# EAGLE schematic MSP-EXP430FR4133_EagleCAD (EAGLE 7.6.0)
REV: 1.1

## Sheet 1 of 6
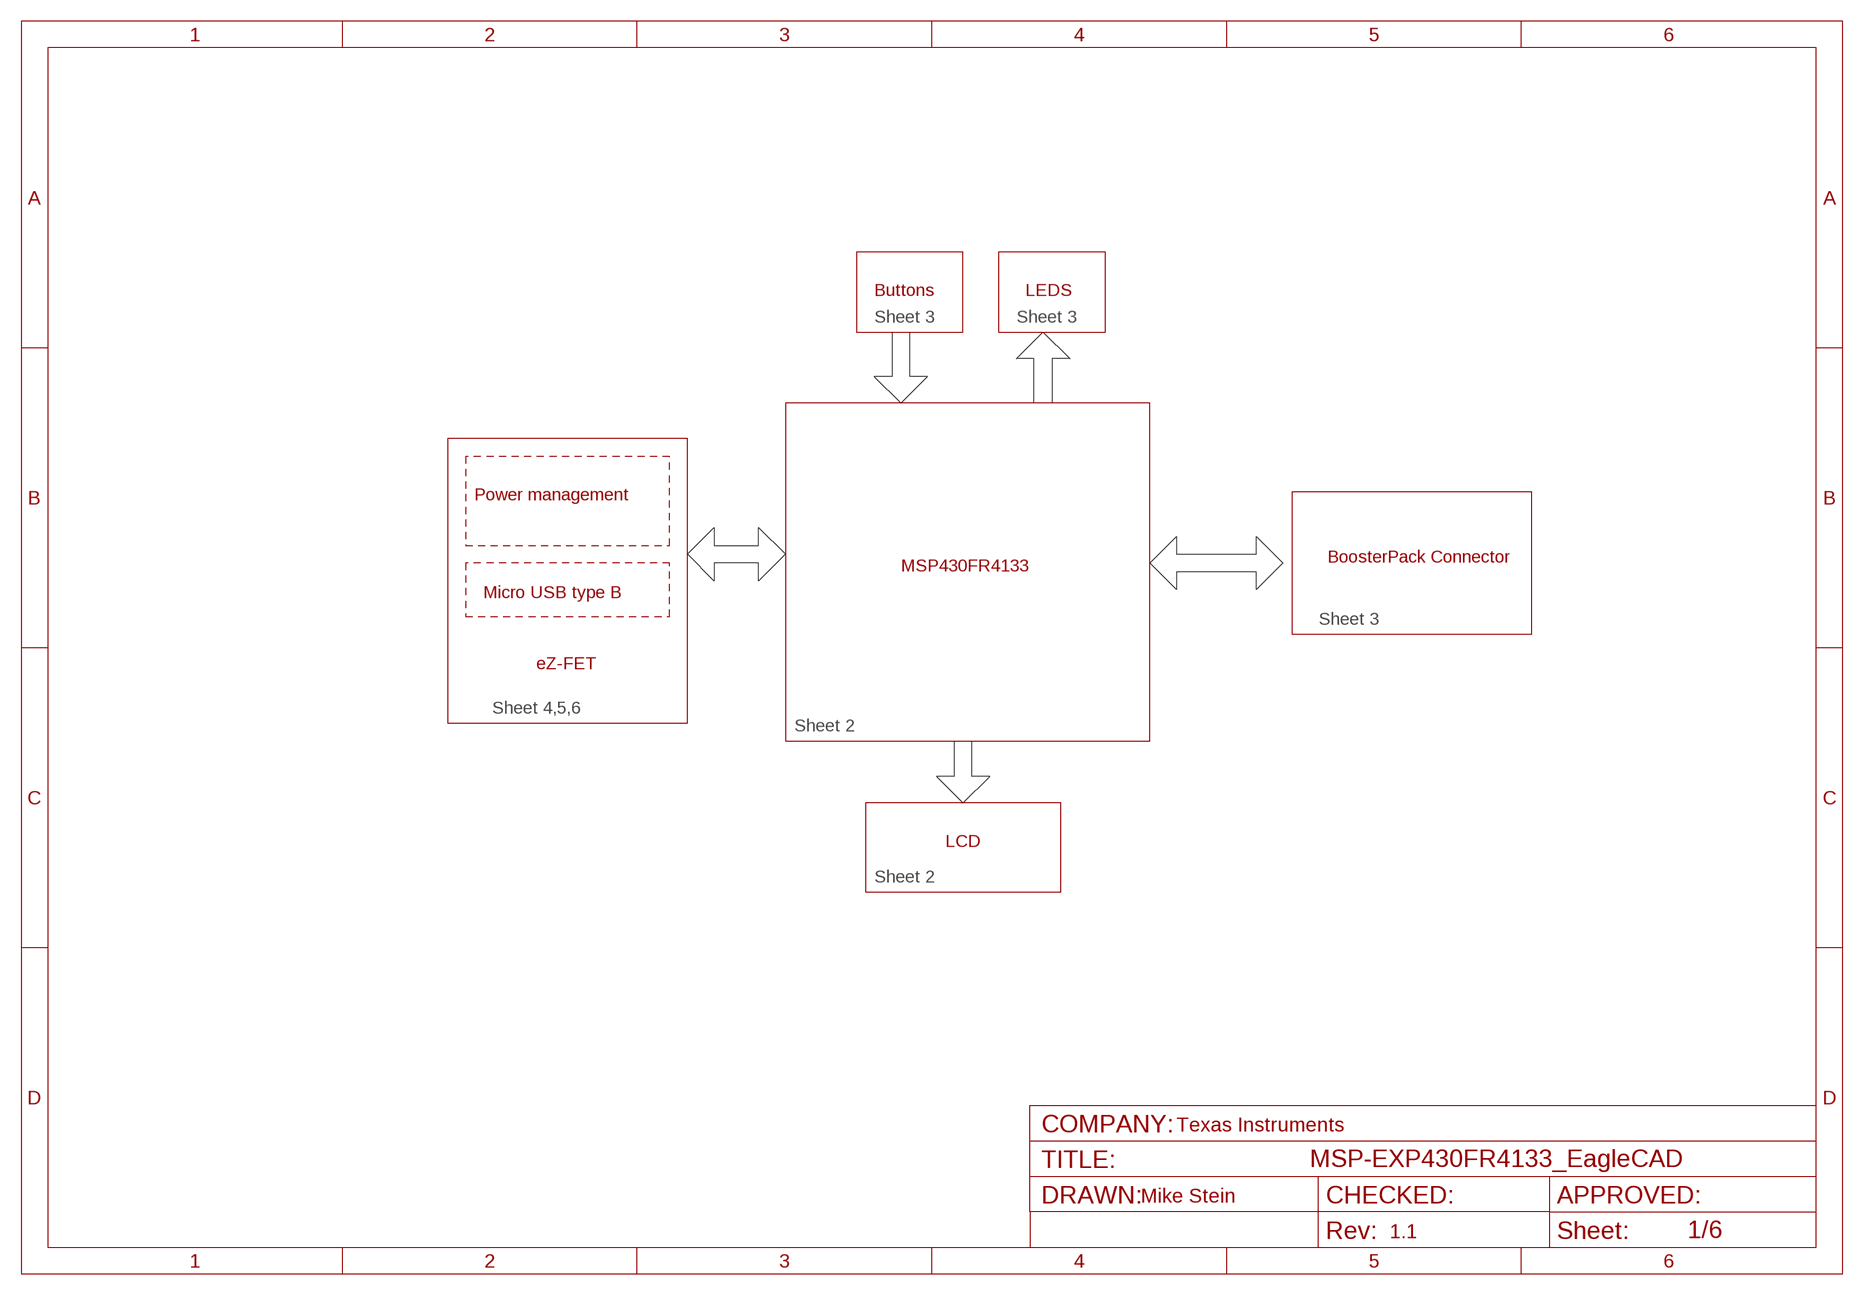
[diagram p0: schematic, sheet 1]

### Notes on the sheet
- Buttons | LEDS
- Sheet 3 | Sheet 3
- Power management
- BoosterPack Connector
- MSP430FR4133
- Micro USB type B
- Sheet 3
- eZ-FET
- Sheet 4,5,6
- Sheet 2
- LCD
- Sheet 2
- Texas Instruments
- Mike Stein

## Sheet 2 of 6
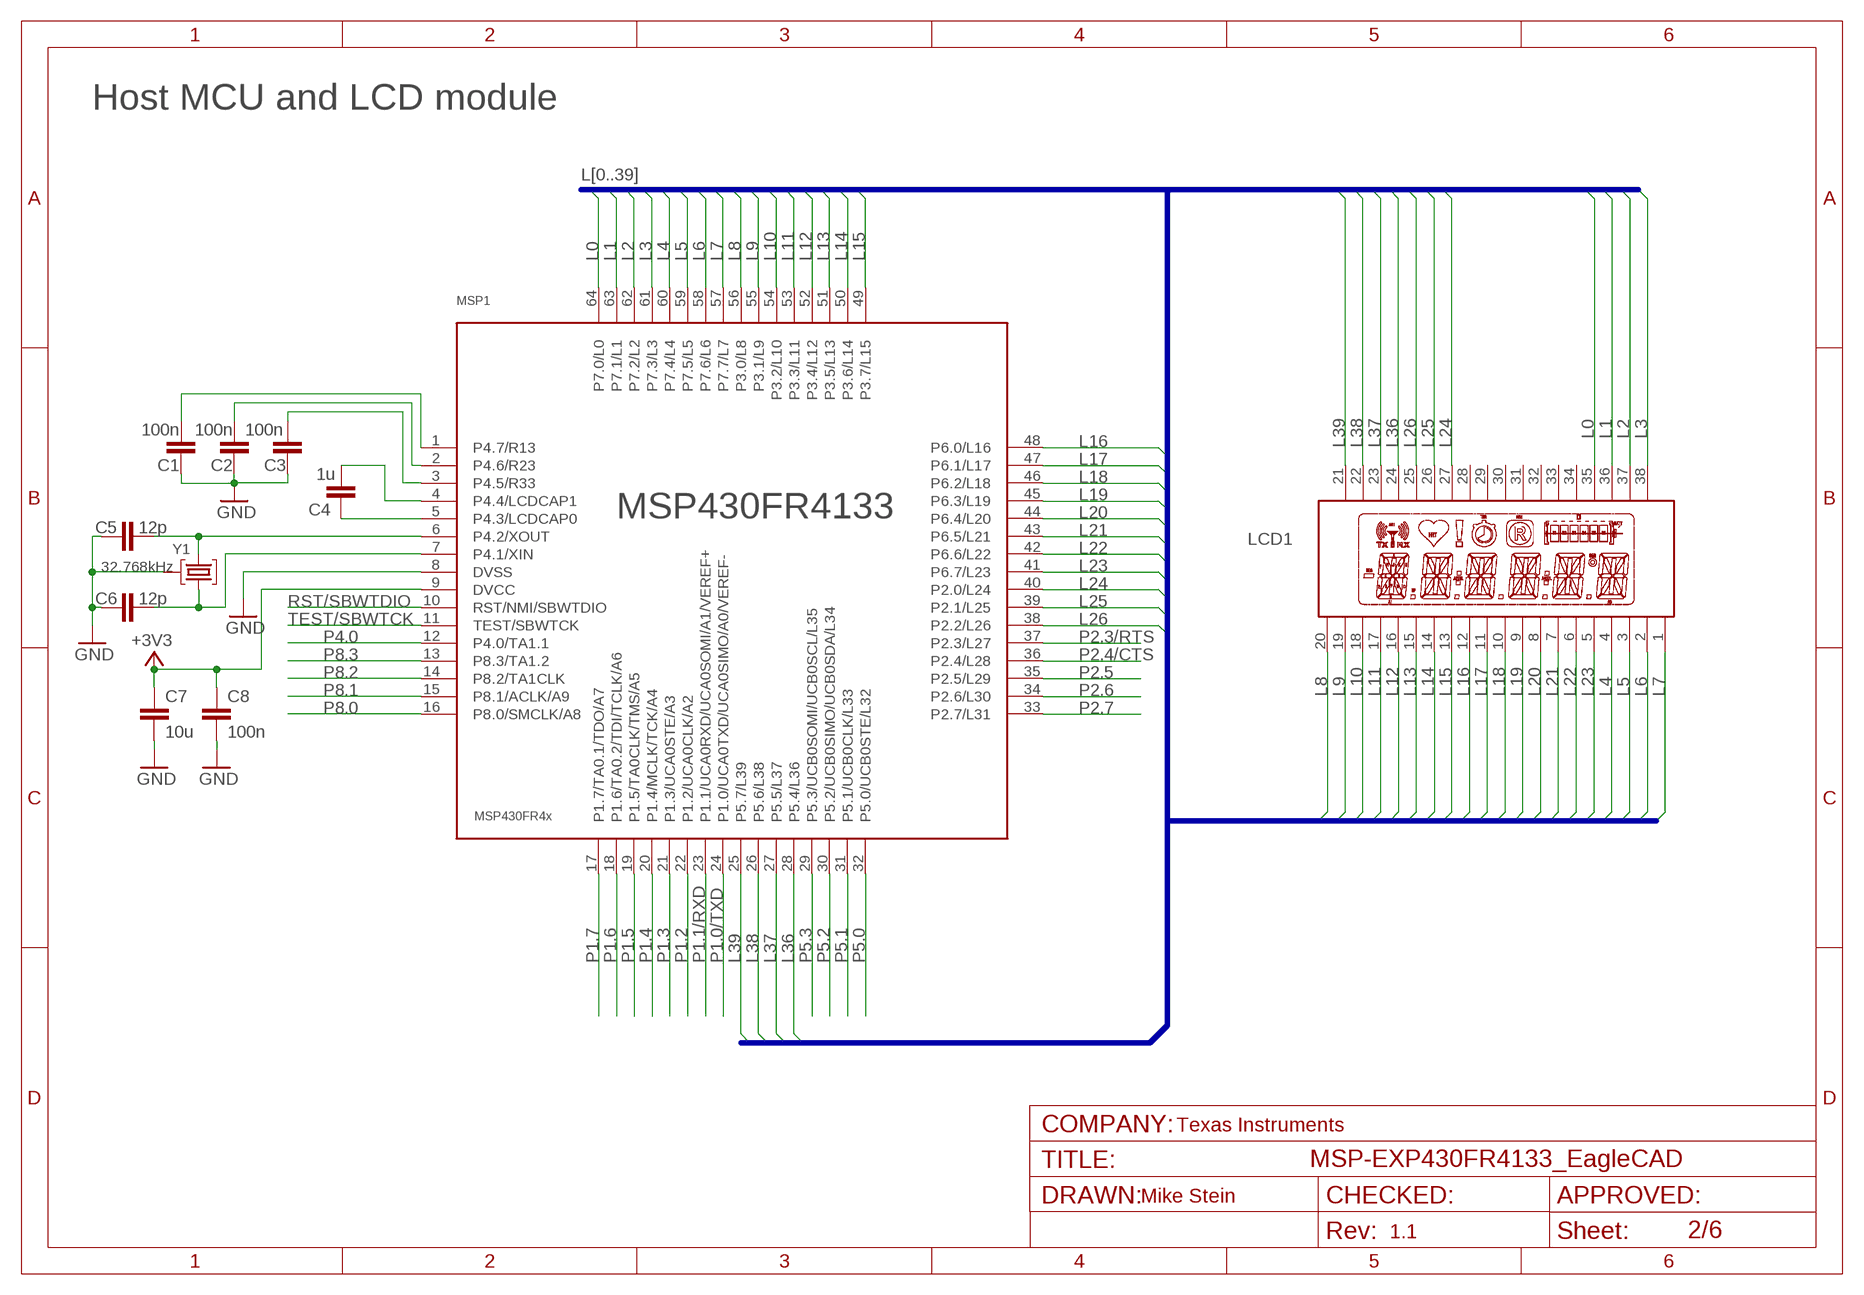
[diagram p1: schematic, sheet 2]

### Parts
C1  100n  C-EUC0402  [C0402]
C2  100n  C-EUC0402  [C0402]
C3  100n  C-EUC0402  [C0402]
C4  1u  C-EUC0402  [C0402]
C5  12p  C-EUC0402  [C0402]
C6  12p  C-EUC0402  [C0402]
C7  10u  C-EUC0603  [C0603]
C8  100n  C-EUC0402  [C0402]
LCD1  FH1138P  [FH1138P]
MSP1  MSP430FR4x  MSP430G621IPM  [LQFP64]
Y1  32.768kHz  MS3V-T1R  [MS3V-T1R]

### Nets
+3V3: C7.1 C8.1 MSP1.9(DVCC) ; also sheet 3,5
GND: C1.2 C2.2 C3.2 C5.2 C6.2 C7.2 C8.2 MSP1.8(DVSS) Y1.P3(GND) ; also sheet 3,4,5,6
L0: LCD1.35 MSP1.64(P7.0/L0)
L1: LCD1.36 MSP1.63(P7.1/L1)
L2: LCD1.37 MSP1.62(P7.2/L2)
L3: LCD1.38 MSP1.61(P7.3/L3)
L4: LCD1.4 MSP1.60(P7.4/L4)
L5: LCD1.3 MSP1.59(P7.5/L5)
L6: LCD1.2 MSP1.58(P7.6/L6)
L7: LCD1.1 MSP1.57(P7.7/L7)
L8: LCD1.20 MSP1.56(P3.0/L8)
L9: LCD1.19 MSP1.55(P3.1/L9)
L10: LCD1.18 MSP1.54(P3.2/L10)
L11: LCD1.17 MSP1.53(P3.3/L11)
L12: LCD1.16 MSP1.52(P3.4/L12)
L13: LCD1.15 MSP1.51(P3.5/L13)
L14: LCD1.14 MSP1.50(P3.6/L14)
L15: LCD1.13 MSP1.49(P3.7/L15)
L16: LCD1.12 MSP1.48(P6.0/L16)
L17: LCD1.11 MSP1.47(P6.1/L17)
L18: LCD1.10 MSP1.46(P6.2/L18)
L19: LCD1.9 MSP1.45(P6.3/L19)
L20: LCD1.8 MSP1.44(P6.4/L20)
L21: LCD1.7 MSP1.43(P6.5/L21)
L22: LCD1.6 MSP1.42(P6.6/L22)
L23: LCD1.5 MSP1.41(P6.7/L23)
L24: LCD1.27 MSP1.40(P2.0/L24)
L25: LCD1.26 MSP1.39(P2.1/L25)
L26: LCD1.25 MSP1.38(P2.2/L26)
L36: LCD1.24 MSP1.28(P5.4/L36)
L37: LCD1.23 MSP1.27(P5.5/L37)
L38: LCD1.22 MSP1.26(P5.6/L38)
L39: LCD1.21 MSP1.25(P5.7/L39)
N$4: C1.1 MSP1.1(P4.7/R13)
N$10: C2.1 MSP1.2(P4.6/R23)
N$11: C4.1 MSP1.4(P4.4/LCDCAP1)
N$14: C5.1 MSP1.6(P4.2/XOUT) Y1.P2
N$17: C4.2 MSP1.5(P4.3/LCDCAP0)
N$18: C6.1 MSP1.7(P4.1/XIN) Y1.P1
N$19: C3.1 MSP1.3(P4.5/R33)
P1.0/TXD: MSP1.24(P1.0/UCA0TXD/UCA0SIMO/A0/VEREF-) ; also sheet 3,5
P1.1/RXD: MSP1.23(P1.1/UCA0RXD/UCA0SOMI/A1/VEREF+) ; also sheet 3,5
P1.2: MSP1.22(P1.2/UCA0CLK/A2) ; also sheet 3
P1.3: MSP1.21(P1.3/UCA0STE/A3) ; also sheet 3
P1.4: MSP1.20(P1.4/MCLK/TCK/A4) ; also sheet 3
P1.5: MSP1.19(P1.5/TA0CLK/TMS/A5) ; also sheet 3
P1.6: MSP1.18(P1.6/TA0.2/TDI/TCLK/A6) ; also sheet 3
P1.7: MSP1.17(P1.7/TA0.1/TDO/A7) ; also sheet 3
P2.3/RTS: MSP1.37(P2.3/L27) ; also sheet 5
P2.4/CTS: MSP1.36(P2.4/L28) ; also sheet 5
P2.5: MSP1.35(P2.5/L29) ; also sheet 3
P2.6: MSP1.34(P2.6/L30) ; also sheet 3
P2.7: MSP1.33(P2.7/L31) ; also sheet 3
P4.0: MSP1.12(P4.0/TA1.1) ; also sheet 3
P5.0: MSP1.32(P5.0/UCB0STE/L32) ; also sheet 3
P5.1: MSP1.31(P5.1/UCB0CLK/L33) ; also sheet 3
P5.2: MSP1.30(P5.2/UCB0SIMO/UCB0SDA/L34) ; also sheet 3
P5.3: MSP1.29(P5.3/UCB0SOMI/UCB0SCL/L35) ; also sheet 3
P8.0: MSP1.16(P8.0/SMCLK/A8) ; also sheet 3
P8.1: MSP1.15(P8.1/ACLK/A9) ; also sheet 3
P8.2: MSP1.14(P8.2/TA1CLK) ; also sheet 3
P8.3: MSP1.13(P8.3/TA1.2) ; also sheet 3
RST/SBWTDIO: MSP1.10(RST/NMI/SBWTDIO) ; also sheet 3,5
TEST/SBWTCK: MSP1.11(TEST/SBWTCK) ; also sheet 5
Unconnected: LCD1.28 LCD1.29 LCD1.30 LCD1.31 LCD1.32 LCD1.33 LCD1.34

### Buses
L[0..39]

### Notes on the sheet
- Host MCU and LCD module
- MSP430FR4133
- Texas Instruments
- Mike Stein

## Sheet 3 of 6
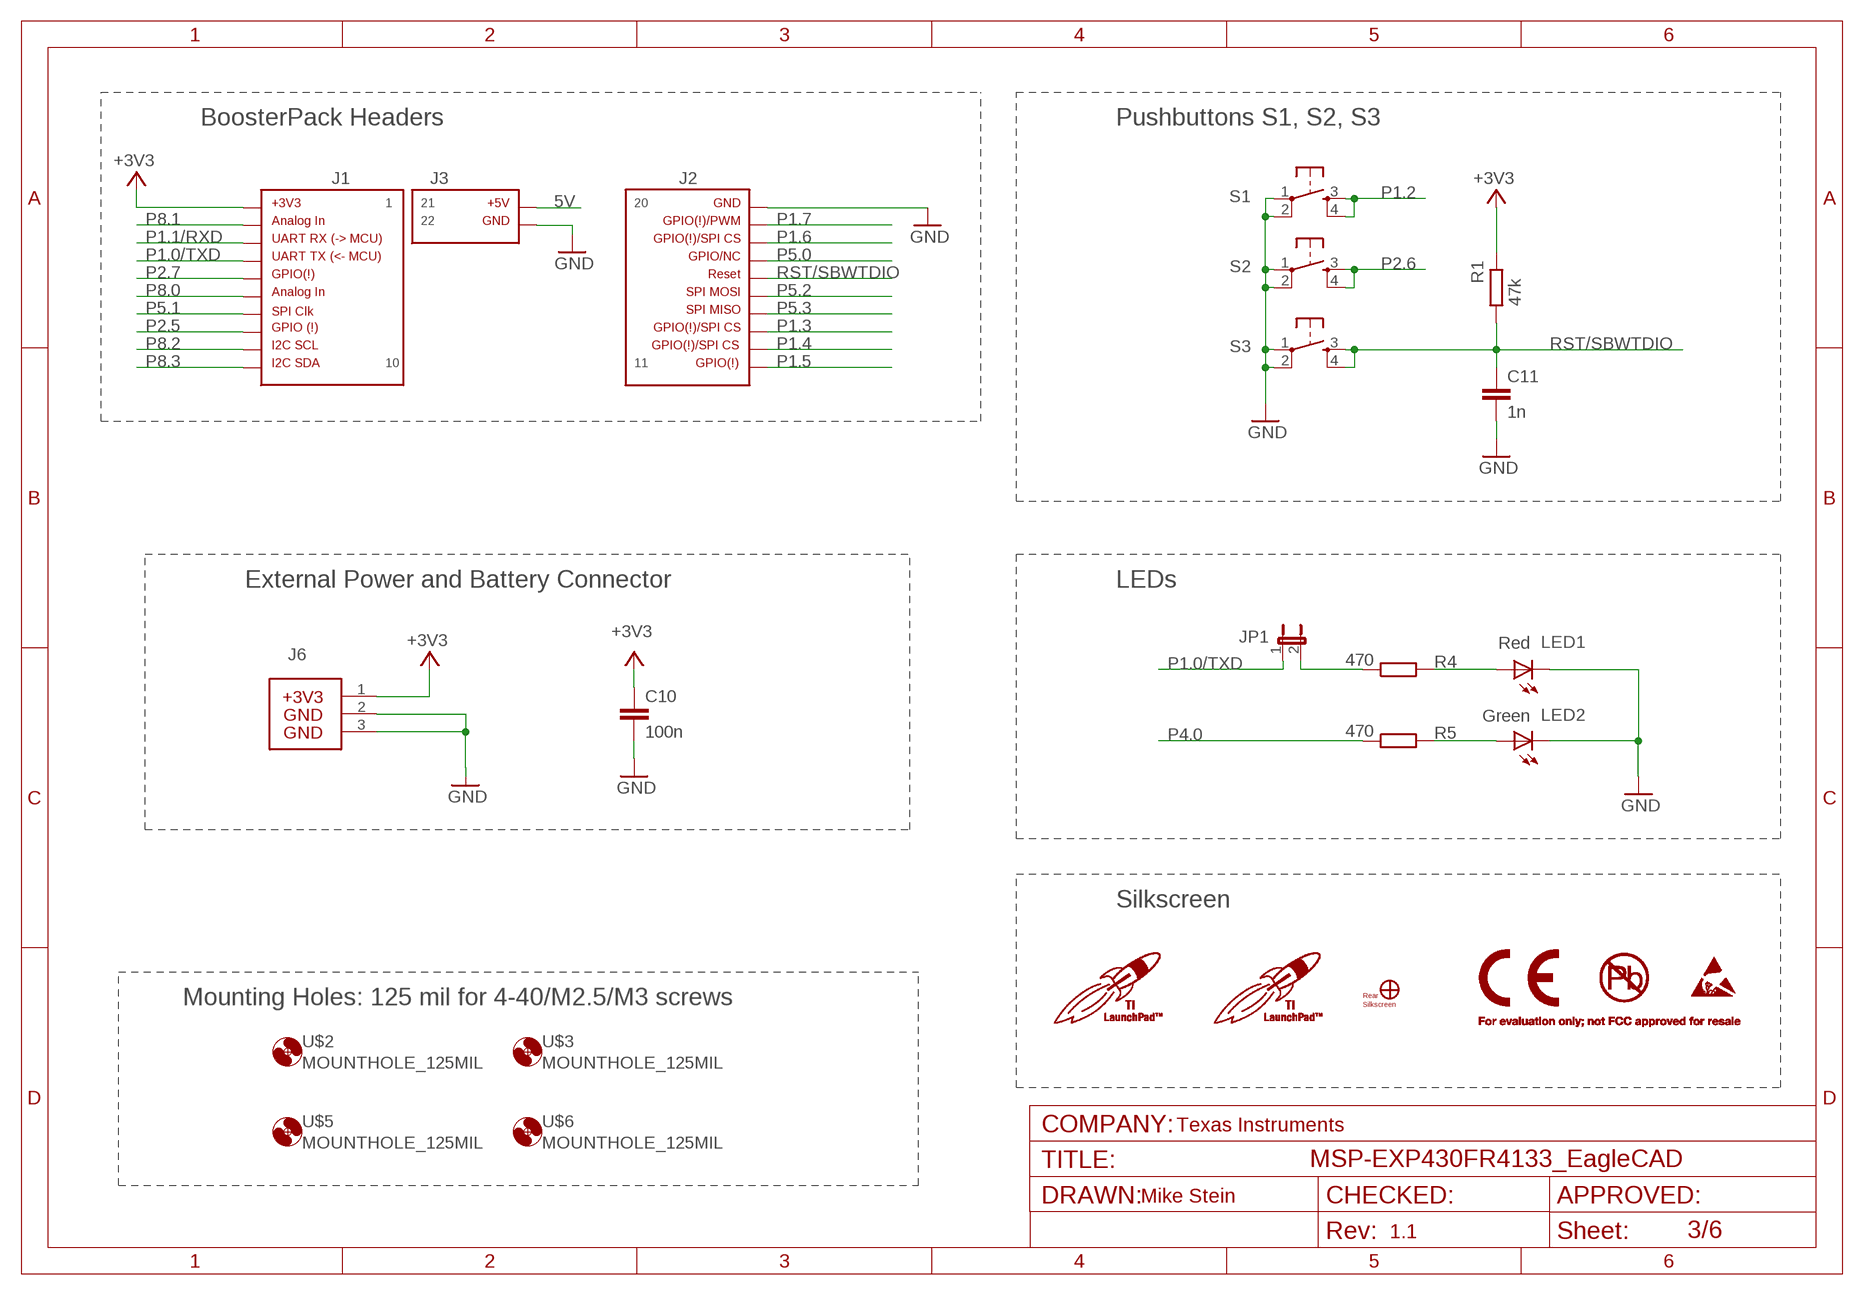
[diagram p2: schematic, sheet 3]

### Parts
C10  100n  C-EUC0402  [C0402]
C11  1n  C-EUC0402  [C0402]
J1  HEADER1X10-J1SILK_LABELS  [J1]
J2  HEADER1X10-J2SILK_LABELS  [J2]
J3  HEADER1X02-J3SILK_LABELS  [J3_2PIN]
J6  HEADER1X03-J5INSIDE_LABEL  [1X03-J5_INSIDE]
JP1  JUMPER_2.51MM  [JUMPER-2.54]
LED1  Red  CHIP-LED  [LED0805]
LED2  Green  CHIP-LED  [LED0805]
R1  47k  R-EU_  [R0402]
R4  470  R-EU_  [R0402]
R5  470  R-EU_  [R0402]
S1  T062S  [T062S]
S2  T062S  [T062S]
S3  T062S  [T062S]
U$1  COMPLIANCE_SUITENOBOX  [EVM_COMPLIANCESUITE_NOBOX]
U$2  MOUNTHOLE_125MIL  [MOUNTHOLE_125MIL]
U$3  MOUNTHOLE_125MIL  [MOUNTHOLE_125MIL]
U$5  MOUNTHOLE_125MIL  [MOUNTHOLE_125MIL]
U$6  MOUNTHOLE_125MIL  [MOUNTHOLE_125MIL]
U$7  LOGO-ROCKET  [LOGO-ROCKET]
U$8  FR4133_REARSILK_REV1_1  [FR4133_REARSILK_REV1_1]
U$9  LOGO-ROCKET  [LOGO-ROCKET]
U$12  MIKE_TM  [MIKE_TM]

### Nets
5V: J3.21 ; also sheet 5
+3V3: C10.1 J1.1 J6.1 R1.1 ; also sheet 2,5
GND: C10.2 C11.2 J2.20 J3.22 J6.2 J6.3 LED1.C LED2.C S1.1 S1.2 S2.1 S2.2 S3.1 S3.2 ; also sheet 2,4,5,6
N$6: JP1.2 R4.1
N$7: LED1.A R4.2
N$8: LED2.A R5.2
P1.0/TXD: J1.4 JP1.1 ; also sheet 2,5
P1.1/RXD: J1.3 ; also sheet 2,5
P1.2: S1.3 S1.4 ; also sheet 2
P1.3: J2.13 ; also sheet 2
P1.4: J2.12 ; also sheet 2
P1.5: J2.11 ; also sheet 2
P1.6: J2.18 ; also sheet 2
P1.7: J2.19 ; also sheet 2
P2.5: J1.8 ; also sheet 2
P2.6: S2.3 S2.4 ; also sheet 2
P2.7: J1.5 ; also sheet 2
P4.0: R5.1 ; also sheet 2
P5.0: J2.17 ; also sheet 2
P5.1: J1.7 ; also sheet 2
P5.2: J2.15 ; also sheet 2
P5.3: J2.14 ; also sheet 2
P8.0: J1.6 ; also sheet 2
P8.1: J1.2 ; also sheet 2
P8.2: J1.9 ; also sheet 2
P8.3: J1.10 ; also sheet 2
RST/SBWTDIO: C11.1 J2.16 R1.2 S3.3 S3.4 ; also sheet 2,5

### Notes on the sheet
- BoosterPack Headers | Pushbuttons S1, S2, S3
- External Power and Battery Connector | LEDs
- Silkscreen
- Mounting Holes: 125 mil for 4-40/M2.5/M3 screws
- Texas Instruments
- Mike Stein

## Sheet 4 of 6
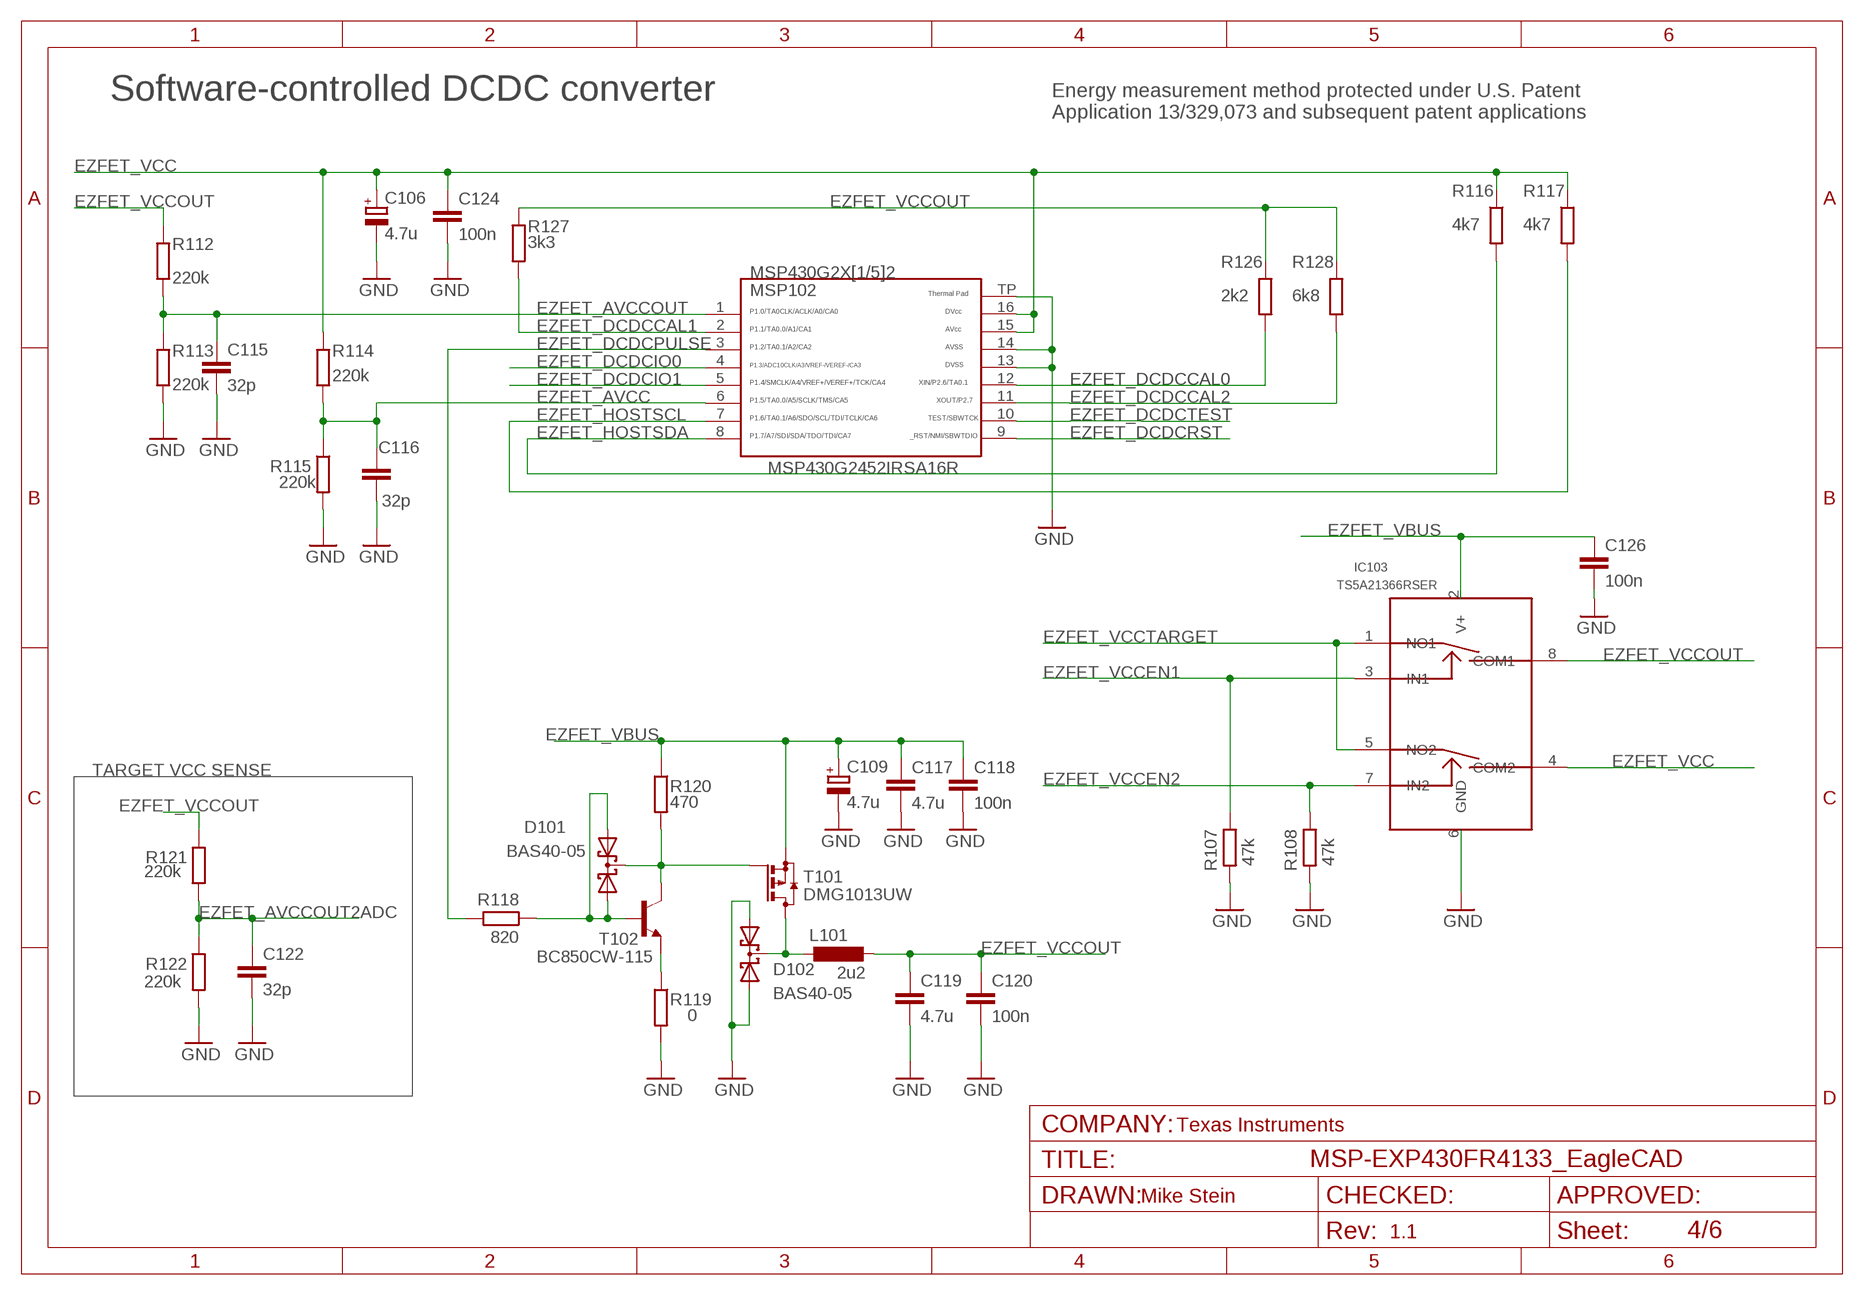
[diagram p3: schematic, sheet 4]

### Parts
C106  4.7u  CPOL-EUA/3216-18R  [A/3216-18R]
C109  4.7u  CPOL-EUA/3216-18R  [A/3216-18R]
C115  32p  C-EUC0402  [C0402]
C116  32p  C-EUC0402  [C0402]
C117  4.7u  C-EUC0603  [C0603]
C118  100n  C-EUC0402  [C0402]
C119  4.7u  C-EUC0603  [C0603]
C120  100n  C-EUC0402  [C0402]
C122  32p  C-EUC0402  [C0402]
C124  100n  C-EUC0402  [C0402]
C126  100n  C-EUC0402  [C0402]
D101  BAS40-05  BAS40-05W  [SOT323]
D102  BAS40-05  BAS40-05W  [SOT323]
IC103  TS5A21366RSER  [UQFN_RSE]
L101  2u2  L-EUL3216C  [L3216C]
MSP102  MSP430G2452IRSA16R  G2X[1/5]2---RSA16  [RSA16]
R107  47k  R-EU_  [R0402]
R108  47k  R-EU_  [R0402]
R112  220k  R-EU_  [R0402]
R113  220k  R-EU_  [R0402]
R114  220k  R-EU_  [R0402]
R115  220k  R-EU_  [R0402]
R116  4k7  R-EU_  [R0402]
R117  4k7  R-EU_  [R0402]
R118  820  R-EU_  [R0402]
R119  0  R-EU_  [R0402]
R120  470  R-EU_  [R0402]
R121  220k  R-EU_  [R0402]
R122  220k  R-EU_  [R0402]
R126  2k2  R-EU_  [R0402]
R127  3k3  R-EU_  [R0402]
R128  6k8  R-EU_  [R0402]
T101  DMG1013UW  [SOT323]
T102  BC850CW-115  [SOT323]

### Nets
EZFET_AVCC: C116.2 MSP102.6 R114.2 R115.1
EZFET_AVCCOUT: C115.2 MSP102.1 R112.2 R113.1
EZFET_AVCCOUT2ADC: C122.2 R121.2 R122.1 ; also sheet 5
EZFET_DCDCCAL0: MSP102.12 R126.2
EZFET_DCDCCAL1: MSP102.2 R127.2
EZFET_DCDCCAL2: MSP102.11 R128.2
EZFET_DCDCIO0: MSP102.4 ; also sheet 5
EZFET_DCDCIO1: MSP102.5 ; also sheet 5
EZFET_DCDCPULSE: MSP102.3 R118.2 ; also sheet 5
EZFET_DCDCRST: MSP102.9 ; also sheet 5,6
EZFET_DCDCTEST: MSP102.10 ; also sheet 5,6
EZFET_HOSTSCL: MSP102.7 R117.2 ; also sheet 5
EZFET_HOSTSDA: MSP102.8 R116.2 ; also sheet 5
EZFET_VBUS: C109.+ C117.1 C118.1 C126.1 IC103.2(V+) R120.1 T101.2(S) ; also sheet 5,6
EZFET_VCC: C106.+ C124.1 IC103.4(COM2) MSP102.15 MSP102.16 R114.1 R116.1 R117.1 ; also sheet 5,6
EZFET_VCCEN1: IC103.3(IN1) R107.1 ; also sheet 5
EZFET_VCCEN2: IC103.7(IN2) R108.1 ; also sheet 5
EZFET_VCCOUT: C119.1 C120.1 IC103.8(COM1) L101.2 R112.1 R121.1 R126.1 R127.1 R128.1
EZFET_VCCTARGET: IC103.1(NO1) IC103.5(NO2) ; also sheet 5
GND: C106.- C109.- C115.1 C116.1 C117.2 C118.2 C119.2 C120.2 C122.1 C124.2 C126.2 D102.1(A1) D102.2(A2) IC103.6(GND) MSP102.13 MSP102.14 MSP102.TP R107.2 R108.2 R113.2 R115.2 R119.2 R122.2 ; also sheet 2,3,5,6
N$12: R119.1 T102.2(E)
N$13: D101.1(A1) D101.2(A2) R118.1 T102.1(B)
N$15: D102.3(C) L101.1 T101.3(D)
N$16: D101.3(C) R120.2 T101.1(G) T102.3(C)

### Notes on the sheet
- Software-controlled DCDC converter
- Energy measurement method protected under U.S. Patent 
  Application 13/329,073 and subsequent patent applications
- MSP430G2452IRSA16R
- TARGET VCC SENSE
- Texas Instruments
- Mike Stein

## Sheet 5 of 6
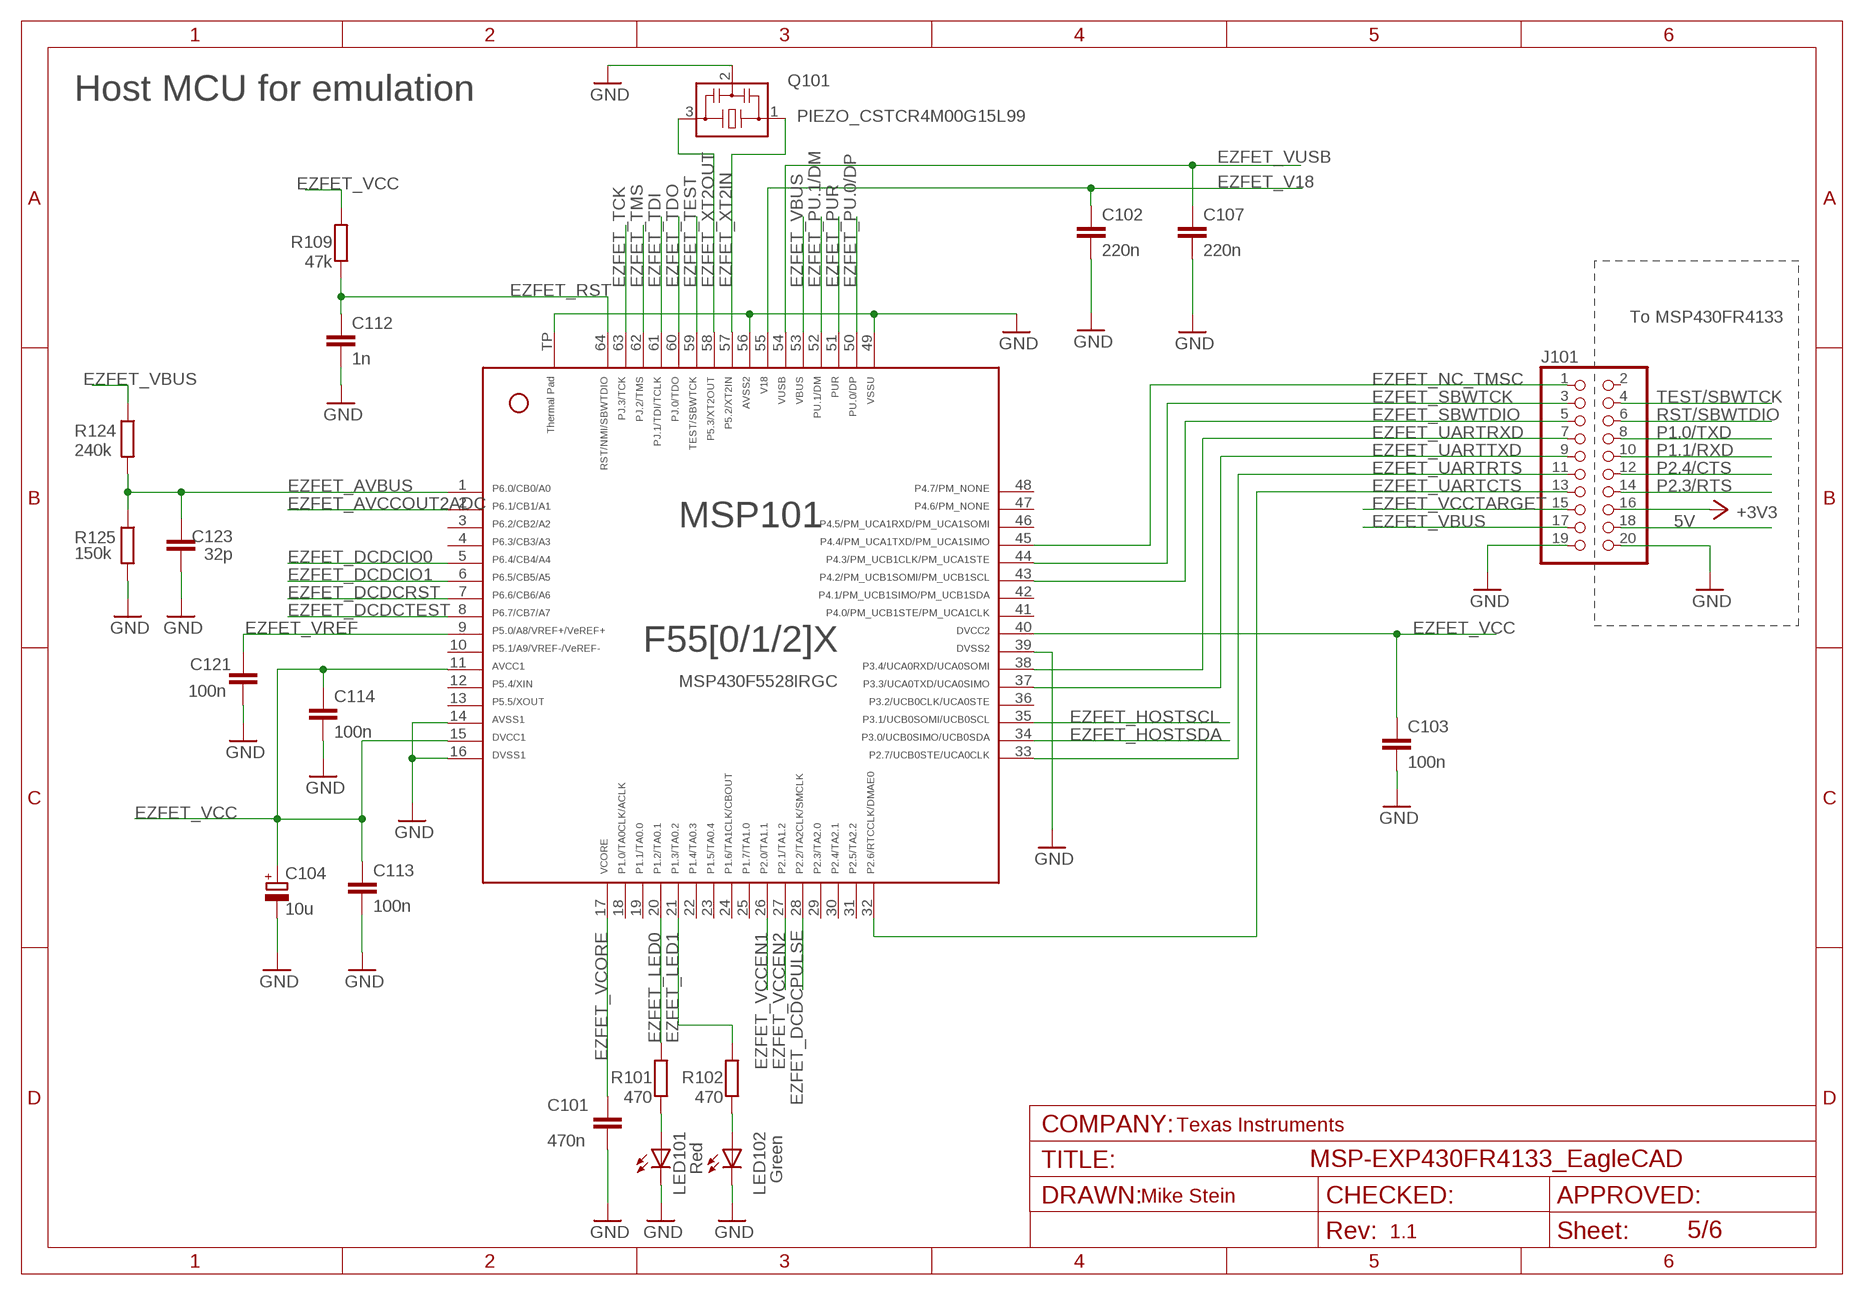
[diagram p4: schematic, sheet 5]

### Parts
C101  470n  C-EUC0402  [C0402]
C102  220n  C-EUC0402  [C0402]
C103  100n  C-EUC0402  [C0402]
C104  10u  CPOL-EUA/3216-18R  [A/3216-18R]
C107  220n  C-EUC0402  [C0402]
C112  1n  C-EUC0402  [C0402]
C113  100n  C-EUC0402  [C0402]
C114  100n  C-EUC0402  [C0402]
C121  100n  C-EUC0402  [C0402]
C123  32p  C-EUC0402  [C0402]
J101  PINHD-2X10  [2X10]
LED101  Red  CHIP-LED  [LED0805]
LED102  Green  CHIP-LED  [LED0805]
MSP101  MSP430F5528IRGC  F55[0/1/2]X---RGC64  [RGC64]
Q101  PIEZO_CSTCR4M00G15L99  CSTCR4M  [CSTCR4M]
R101  470  R-EU_  [R0402]
R102  470  R-EU_  [R0402]
R109  47k  R-EU_  [R0402]
R124  240k  R-EU_  [R0402]
R125  150k  R-EU_  [R0402]

### Nets
5V: J101.18 ; also sheet 3
+3V3: J101.16 ; also sheet 2,3
EZFET_AVBUS: C123.2 MSP101.1 R124.2 R125.1
EZFET_AVCCOUT2ADC: MSP101.2 ; also sheet 4
EZFET_DCDCIO0: MSP101.5 ; also sheet 4
EZFET_DCDCIO1: MSP101.6 ; also sheet 4
EZFET_DCDCPULSE: MSP101.28 ; also sheet 4
EZFET_DCDCRST: MSP101.7 ; also sheet 4,6
EZFET_DCDCTEST: MSP101.8 ; also sheet 4,6
EZFET_HOSTSCL: MSP101.35 ; also sheet 4
EZFET_HOSTSDA: MSP101.34 ; also sheet 4
EZFET_LED0: MSP101.20 R101.2
EZFET_LED1: MSP101.21 R102.2
EZFET_NC_TMSC: J101.1 MSP101.45
EZFET_PU.0/DP: MSP101.50 ; also sheet 6
EZFET_PU.1/DM: MSP101.52 ; also sheet 6
EZFET_PUR: MSP101.51 ; also sheet 6
EZFET_RST: C112.1 MSP101.64 R109.1 ; also sheet 6
EZFET_SBWTCK: J101.3 MSP101.44
EZFET_SBWTDIO: J101.5 MSP101.43
EZFET_TCK: MSP101.63 ; also sheet 6
EZFET_TDI: MSP101.61 ; also sheet 6
EZFET_TDO: MSP101.60 ; also sheet 6
EZFET_TEST: MSP101.59 ; also sheet 6
EZFET_TMS: MSP101.62 ; also sheet 6
EZFET_UARTCTS: J101.13 MSP101.32
EZFET_UARTRTS: J101.11 MSP101.33
EZFET_UARTRXD: J101.7 MSP101.38
EZFET_UARTTXD: J101.9 MSP101.37
EZFET_V18: C102.1 MSP101.55
EZFET_VBUS: J101.17 MSP101.53 R124.1 ; also sheet 4,6
EZFET_VCC: C103.1 C104.+ C113.1 C114.1 MSP101.11 MSP101.15 MSP101.40 R109.2 ; also sheet 4,6
EZFET_VCCEN1: MSP101.26 ; also sheet 4
EZFET_VCCEN2: MSP101.27 ; also sheet 4
EZFET_VCCTARGET: J101.15 ; also sheet 4
EZFET_VCORE: C101.1 MSP101.17
EZFET_VREF: C121.1 MSP101.9
EZFET_VUSB: C107.1 MSP101.54
EZFET_XT2IN: MSP101.57 Q101.1
EZFET_XT2OUT: MSP101.58 Q101.3
GND: C101.2 C102.2 C103.2 C104.- C107.2 C112.2 C113.2 C114.2 C121.2 C123.1 J101.19 J101.20 LED101.C LED102.C MSP101.14 MSP101.16 MSP101.39 MSP101.49 MSP101.56 MSP101.TP Q101.2 R125.2 ; also sheet 2,3,4,6
N$1: LED101.A R101.1
N$2: LED102.A R102.1
P1.0/TXD: J101.8 ; also sheet 2,3
P1.1/RXD: J101.10 ; also sheet 2,3
P2.3/RTS: J101.14 ; also sheet 2
P2.4/CTS: J101.12 ; also sheet 2
RST/SBWTDIO: J101.6 ; also sheet 2,3
TEST/SBWTCK: J101.4 ; also sheet 2
Unconnected: J101.2 MSP101.3 MSP101.4 MSP101.10 MSP101.12 MSP101.13 MSP101.18 MSP101.19 MSP101.22 MSP101.23 MSP101.24 MSP101.25 MSP101.29 MSP101.30 MSP101.31 MSP101.36 MSP101.41 MSP101.42 MSP101.46 MSP101.47 MSP101.48

### Notes on the sheet
- Host MCU for emulation
- To MSP430FR4133
- MSP430F5528IRGC
- Texas Instruments
- Mike Stein

## Sheet 6 of 6
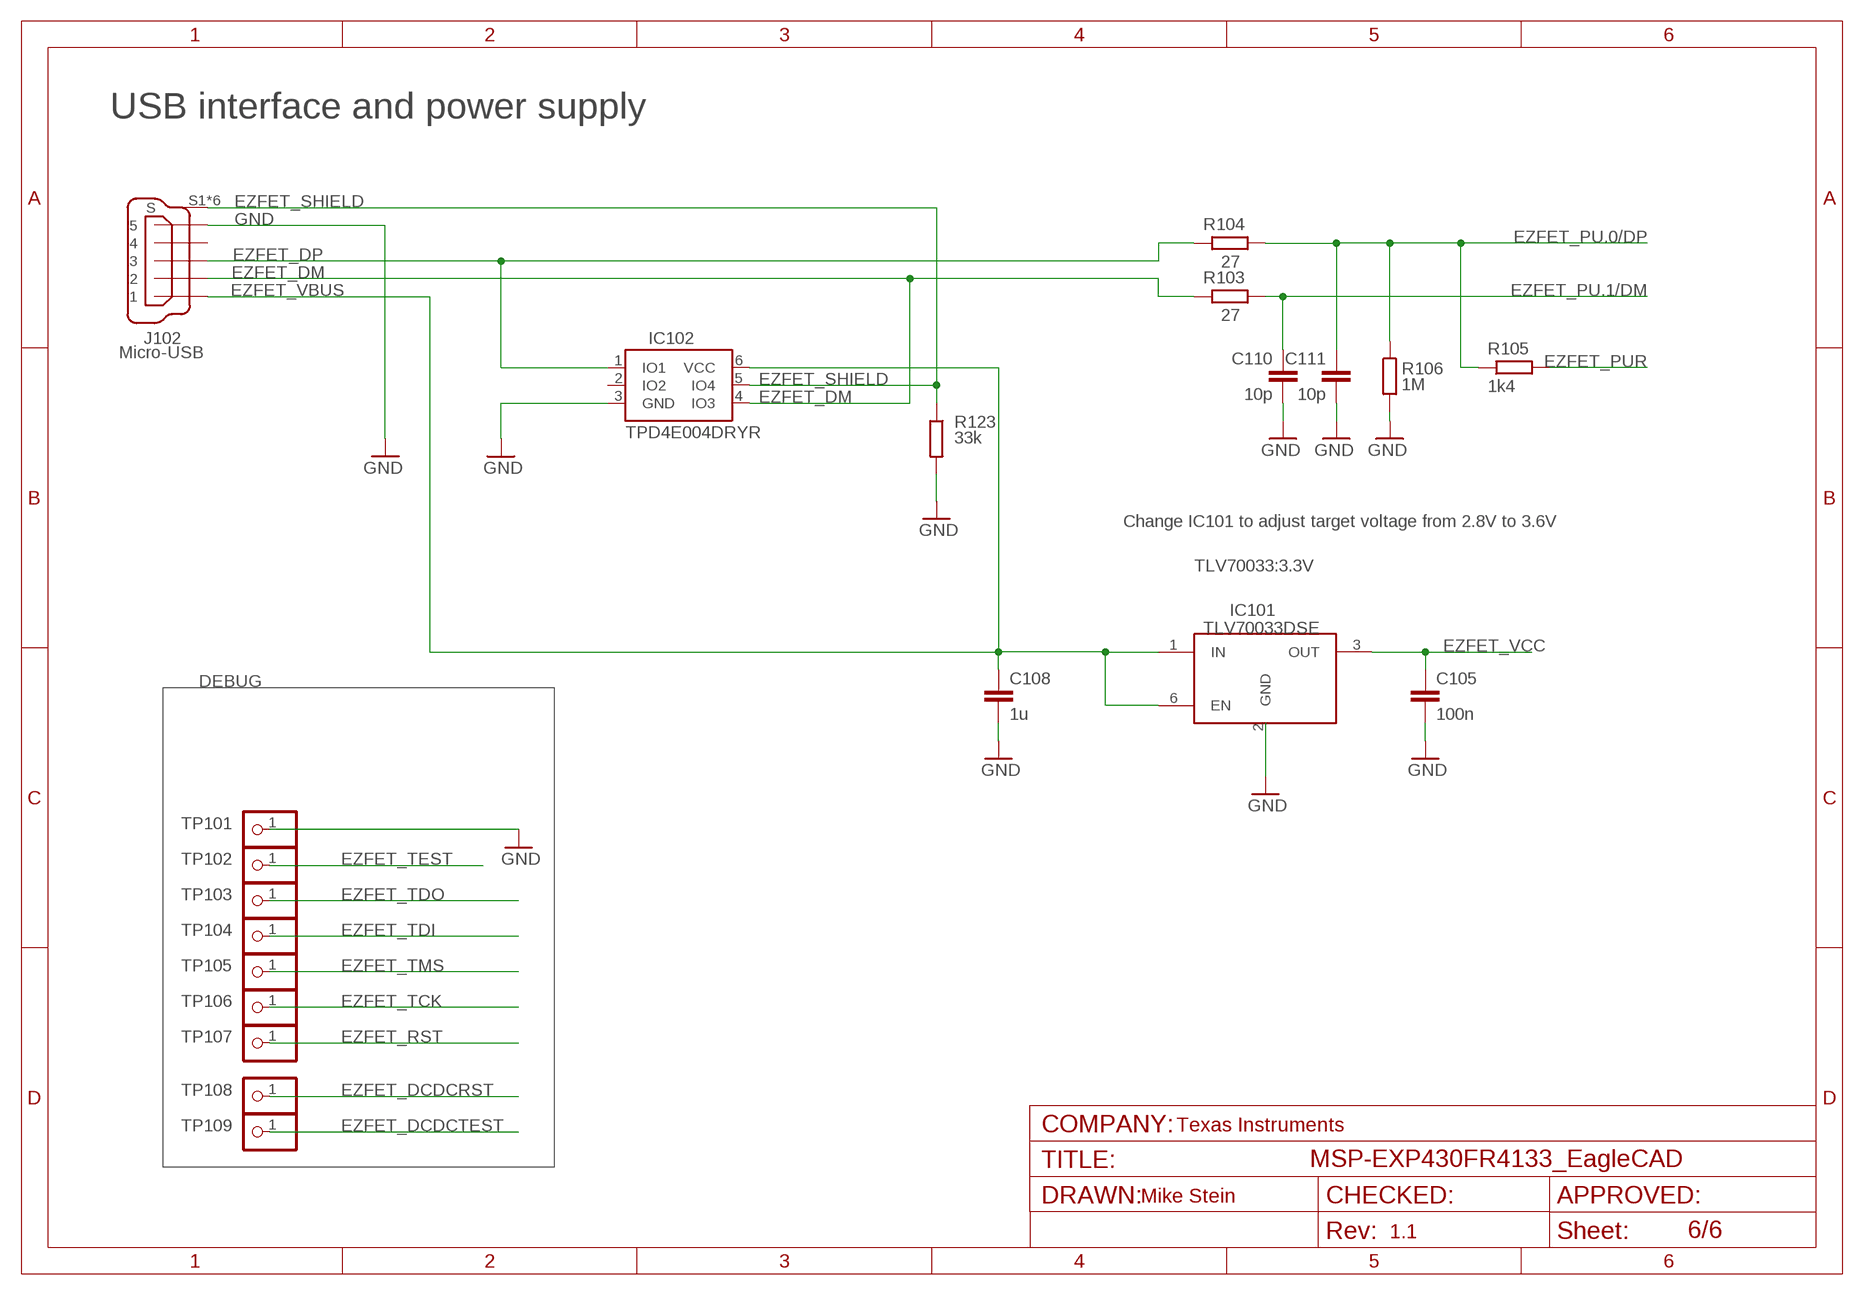
[diagram p5: schematic, sheet 6]

### Parts
C105  100n  C-EUC0402  [C0402]
C108  1u  C-EUC0603  [C0603]
C110  10p  C-EUC0402  [C0402]
C111  10p  C-EUC0402  [C0402]
IC101  TLV70033DSE  [WSON_DSE]
IC102  TPD4E004DRYR  TPD4E004  [SON(DRY)6]
J102  Micro-USB  EZFET_MINI-USB-  [EZFET_UX62M-B-5P]
R103  27  R-EU_  [R0402]
R104  27  R-EU_  [R0402]
R105  1k4  R-EU_  [R0402]
R106  1M  R-EU_  [R0402]
R123  33k  R-EU_  [R0402]
TP101  TEST_PIN2  PINHD-1X1  [1X01]
TP102  TEST_PIN2  PINHD-1X1  [1X01]
TP103  TEST_PIN2  PINHD-1X1  [1X01]
TP104  TEST_PIN2  PINHD-1X1  [1X01]
TP105  TEST_PIN2  PINHD-1X1  [1X01]
TP106  TEST_PIN2  PINHD-1X1  [1X01]
TP107  TEST_PIN2  PINHD-1X1  [1X01]
TP108  TEST_PIN2  PINHD-1X1  [1X01]
TP109  TEST_PIN2  PINHD-1X1  [1X01]

### Nets
EZFET_DCDCRST: TP108.1 ; also sheet 4,5
EZFET_DCDCTEST: TP109.1 ; also sheet 4,5
EZFET_DM: IC102.4(IO3) J102.2 R103.1
EZFET_DP: IC102.1(IO1) J102.3 R104.1
EZFET_PU.0/DP: C111.1 R104.2 R105.1 R106.1 ; also sheet 5
EZFET_PU.1/DM: C110.1 R103.2 ; also sheet 5
EZFET_PUR: R105.2 ; also sheet 5
EZFET_RST: TP107.1 ; also sheet 5
EZFET_SHIELD: IC102.5(IO4) J102.S1(S) J102.S2(S) J102.S3(S) J102.S4(S) J102.S5(S) J102.S6(S) R123.1
EZFET_TCK: TP106.1 ; also sheet 5
EZFET_TDI: TP104.1 ; also sheet 5
EZFET_TDO: TP103.1 ; also sheet 5
EZFET_TEST: TP102.1 ; also sheet 5
EZFET_TMS: TP105.1 ; also sheet 5
EZFET_VBUS: C108.1 IC101.1(IN) IC101.6(EN) IC102.6(VCC) J102.1 ; also sheet 4,5
EZFET_VCC: C105.1 IC101.3(OUT) ; also sheet 4,5
GND: C105.2 C108.2 C110.2 C111.2 IC101.2(GND) IC102.3(GND) J102.5 R106.2 R123.2 TP101.1 ; also sheet 2,3,4,5
Unconnected: IC102.2(IO2) J102.4

### Notes on the sheet
- USB interface and power supply
- Change IC101 to adjust target voltage from 2.8V to 3.6V
- TLV70033:3.3V
- TLV70033DSE
- DEBUG
- Texas Instruments
- Mike Stein

## Library data of the parts
C1-C8 C10 C11 C101-C103 C105 C107 C108 C110-C124 C126 = rcl:C-EU: CAPACITOR, European symbol
C104 C106 C109 = rcl:CPOL-EU: POLARIZED CAPACITOR, European symbol
D101 D102 = MSP430G6_LP:BAS40-05W
IC101 = roy:TLV70033DSE: 200-mA, Low-I Q , Low-Dropout Regulator for Portable Devices
IC102 = eZFET:TPD4E004
IC103 = roy:TS5A21366RSER: 0.75-Ω DUAL SPST ANALOG SWITCH WITH 1.8-V COMPATIBLE INPUT LOGIC
J1 = MSP430_Headers:HEADER1X10-J1
J2 = MSP430_Headers:HEADER1X10-J2
J3 = MSP430_Headers:HEADER1X02-J3
J6 = MSP430_Headers:HEADER1X03-J5
J101 = pinhead:PINHD-2X10: PIN HEADER
J102 = MSP-EXP430G6021:EZFET_MINI-USB-: MINI USB Connector Source: http://www.hirose.co.jp/cataloge_hp/e24000019.pdf
JP1 = launchpad:JUMPER_2.51MM
L101 = rcl:L-EU: INDUCTOR, European symbol
LCD1 = MSP430G6_LP:FH1138P
LED1 LED2 LED101 LED102 = launchpad:CHIP-LED
MSP1 = MSP430G6_LP:MSP430G621IPM
MSP101 = TI_MSP430_v16:F55[0/1/2]X---RGC64: ***F55[0/1/2]X***RGC64 Rev. 1.0 06/2010 "http://www.ti.com/lit/gpn/msp430f5529" "http://www.ti.com/lit/gpn/msp430f5509" F5513/F5514 with limited Functions on some Pins
MSP102 = TI_MSP430_v16:G2X[1/5]2---RSA16: MSP430G2X[1/5]2 MSP430G2x52, MSP430G2x12 QFN (RSA) 16 Pin Package http://focus.ti.com/docs/prod/folders/print/msp430g2452.html
Q101 = MSP430G6_LP:CSTCR4M
R1 R4 R5 R101-R109 R112-R128 = rcl:R-EU_: RESISTOR, European symbol
S1-S3 = launchpad:T062S
T101 = MSP430G6_LP:DMG1013UW
T102 = MSP430G6_LP:BC850CW-115
TP101-TP109 = pinhead:PINHD-1X1: PIN HEADER
U$1 = MSP430_Silkscreen:COMPLIANCE_SUITE
U$2 U$3 U$5 U$6 = MSP-EXP432:MOUNTHOLE_125MIL
U$7 U$9 = MSP430_Silkscreen:LOGO-ROCKET
U$8 = MSP430_Silkscreen:FR4133_REARSILK_REV1_1
U$12 = Mike:MIKE_TM
Y1 = microcrystal:MS3V-T1R